# EasyEDA Pro project URADORRY-SUN1.2.eprj, schematic Sub - MAX3421E(1.2)
Create Date: 2024-06-10; Page Name: base; Project Name: URADORRY-SUN; Schematic Name: Sub - MAX3421E(1.2); Update Date: 2024-06-11; Add into BOM: yes; Company: 整数71の情報処理; Convert to PCB: yes; Drawed: 整数71
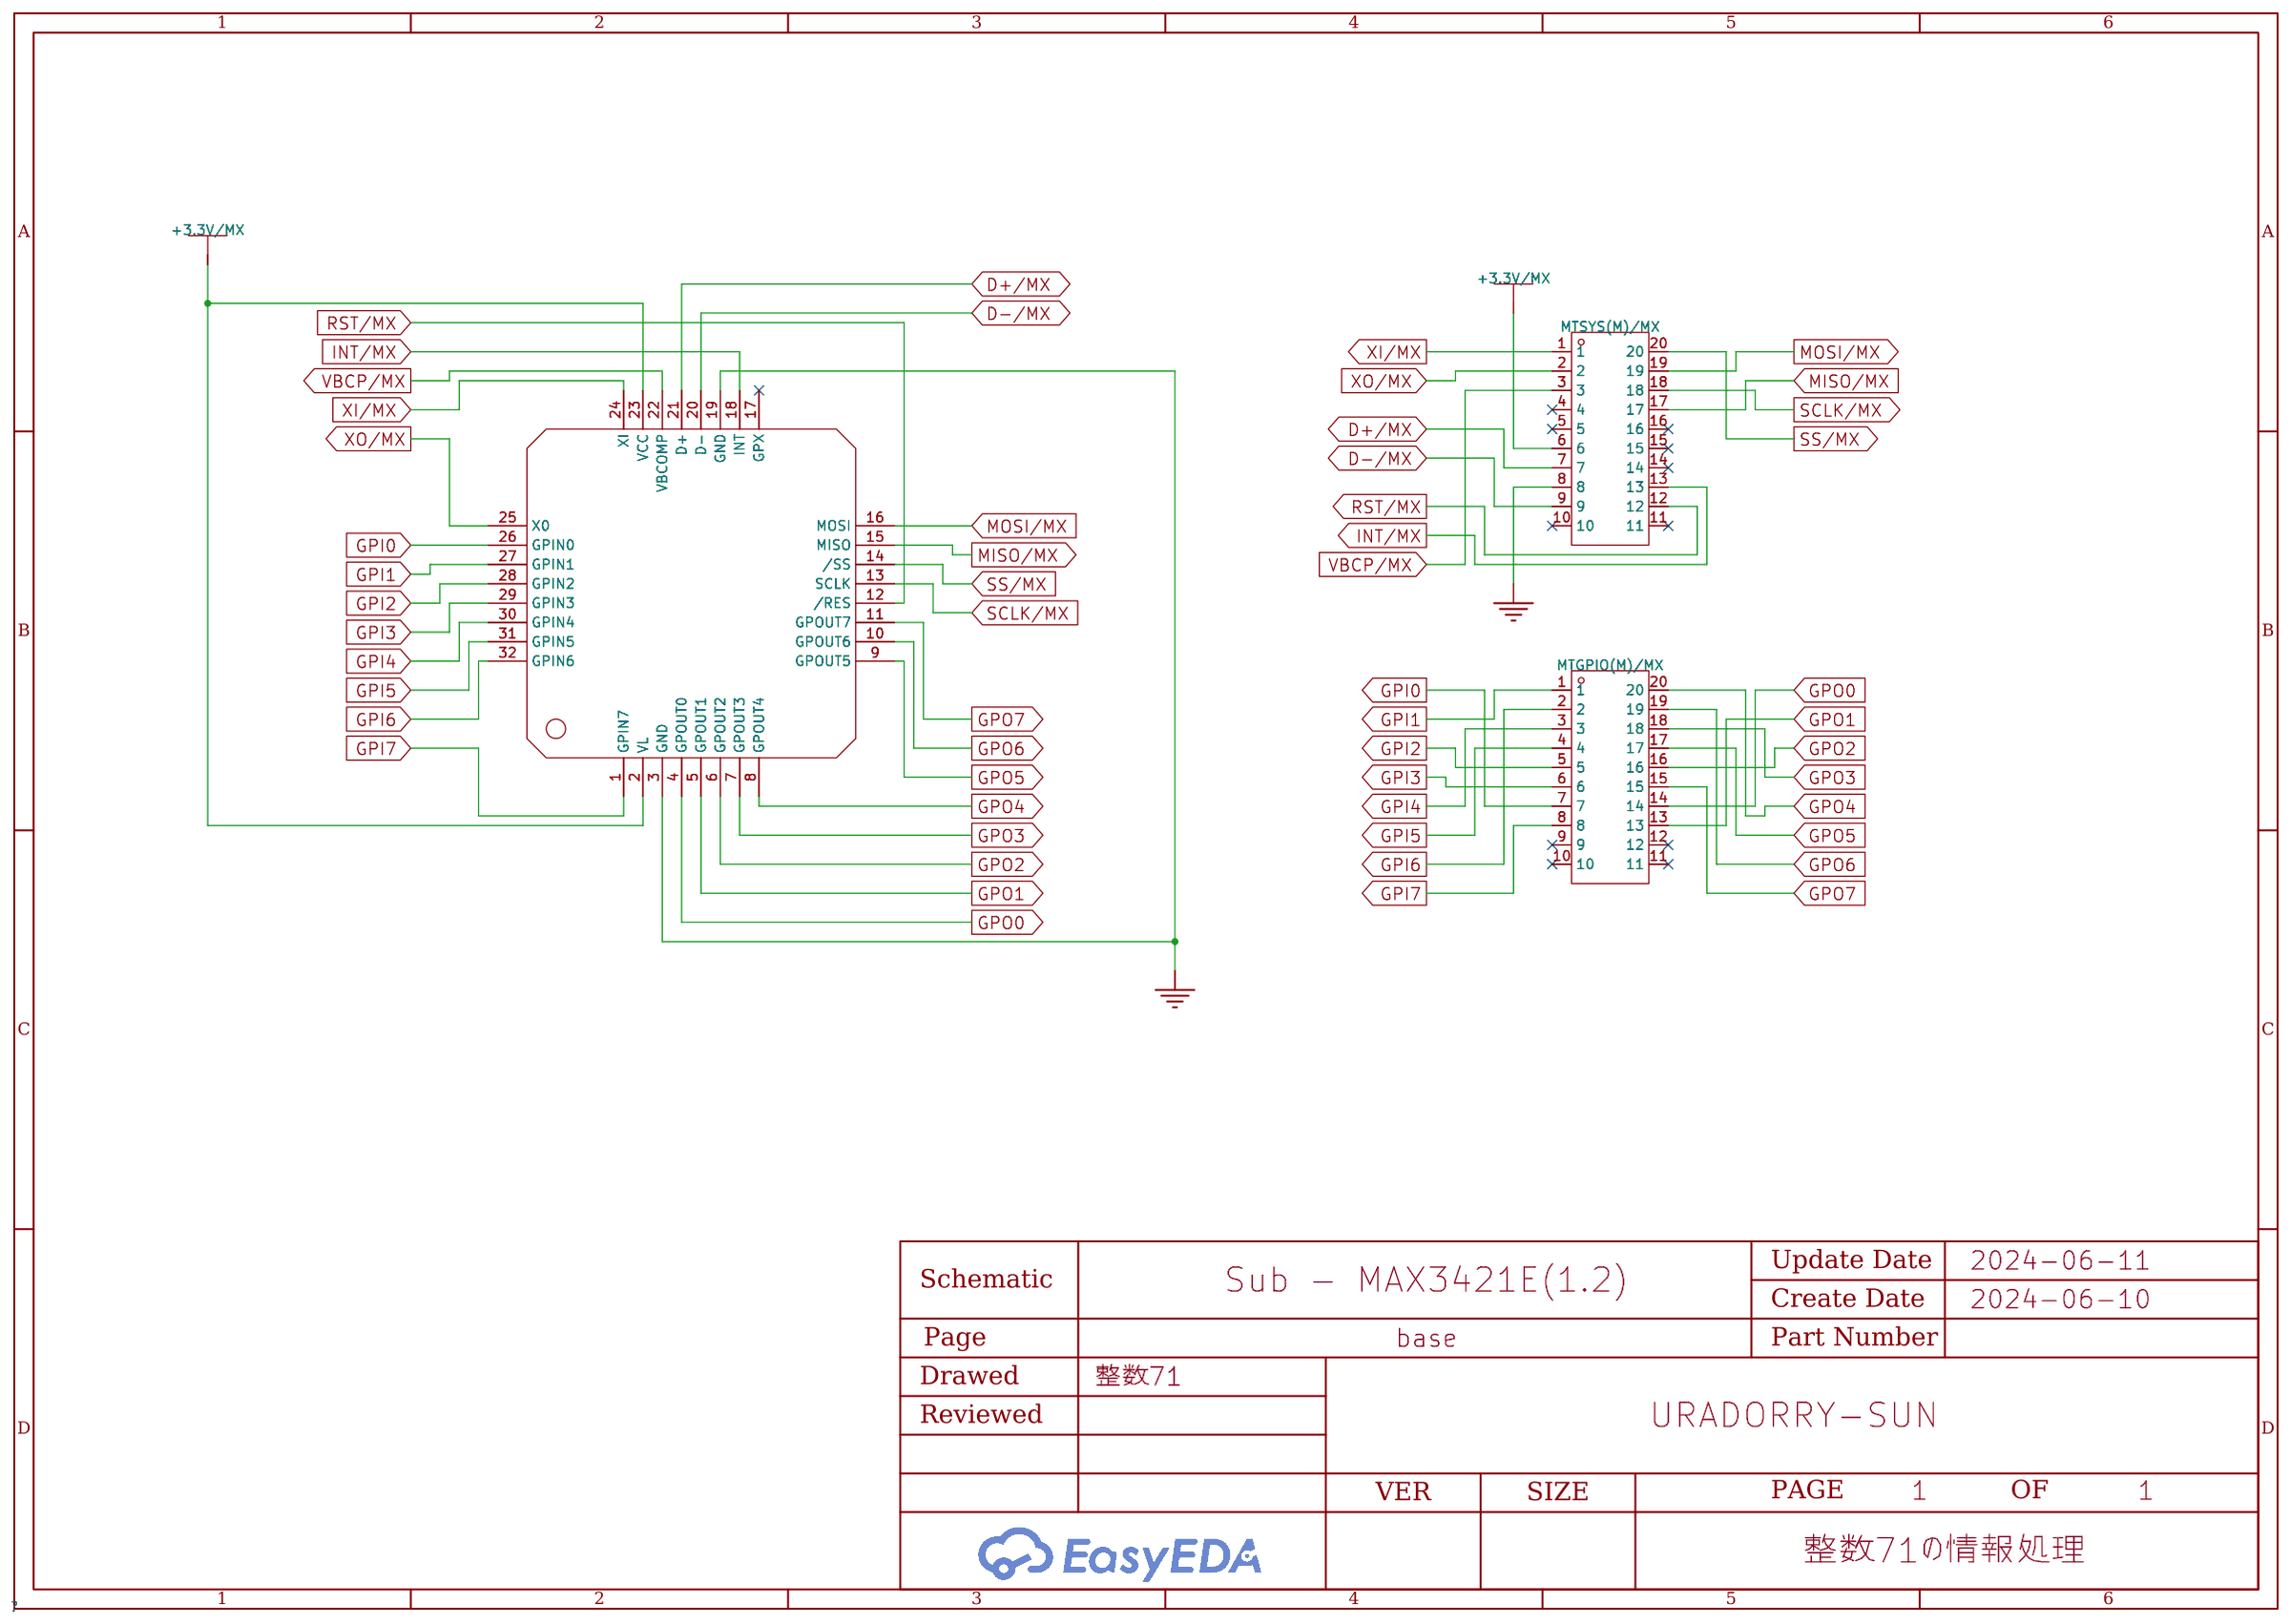
[diagram p0: schematic sheet]

## Parts
MAX3421E  MAX3421EEHJ+T  [TQFP-32_L5.0-W5.0-P0.50-LS7.0-BL]
MTGPIO(M)/MX  AXK6F20547YG  [CONN-SMD_20P-P0.50_C2917022]
MTSYS(M)/MX  AXK6F20547YG  [CONN-SMD_20P-P0.50_C2917022]

## Library data of the parts
MAX3421E = MAX3421EEHJ+T: Applications Function: Protocol:SPI Supply Voltage:3V~3.6V Supply Voltage:3V~3.6V Operating Temperature:-40℃~+85℃ Operating Temperature:-40℃~+85℃; Supplier Part: C2651881; Manufacturer: ADI(亚德诺)/MAXIM(美信); Supplier Footprint: TQFP-32(5x5); JLCPCB Part Class: Extended Part; Datasheet: https://atta.szlcsc.com/upload/public/pdf/source/20210605/F813BE6628303343E236A60FF1C5CBC3.pdf; Supplier: LCSC; Protocol: SPI; Supply Voltage: 3V~3.6V; Operating Temperature: -40℃~+85℃; Check: true
MTGPIO(M)/MX MTSYS(M)/MX = Mezzanine(20M) - SMD0.5mm: Number of Pins:- Pitch:0.5mm Gender:公 Mounting Style:Brick nogging Number of Rows:2 Contact Plating:Gold; LCSC Part Name: 间距:0.5mm 公 立贴; Supplier Part: C2917022; Manufacturer: PANASONIC(松下); Supplier Footprint: SMD,P=0.5mm; JLCPCB Part Class: Extended Part; Datasheet: https://atta.szlcsc.com/upload/public/pdf/source/20220311/6F5DC41F043C9CF6954EB51995931AE2.pdf; Supplier: LCSC; Pitch: 0.5mm; Gender: 公; Mounting Style: Brick nogging; Number of Rows: 2; Contact Plating: Gold

## Nets
GND: MAX3421E.3(GND) MAX3421E.19(GND) MTSYS(M)/MX.8
+3.3V/MX: MAX3421E.2(VL) MAX3421E.23(VCC) MTSYS(M)/MX.6
D+/MX: MAX3421E.21(D+) MTSYS(M)/MX.7
D-/MX: MAX3421E.20(D-) MTSYS(M)/MX.9
GPI0: MAX3421E.26(GPIN0) MTGPIO(M)/MX.7
GPI1: MAX3421E.27(GPIN1) MTGPIO(M)/MX.1
GPI2: MAX3421E.28(GPIN2) MTGPIO(M)/MX.5
GPI3: MAX3421E.29(GPIN3) MTGPIO(M)/MX.6
GPI4: MAX3421E.30(GPIN4) MTGPIO(M)/MX.3
GPI5: MAX3421E.31(GPIN5) MTGPIO(M)/MX.4
GPI6: MAX3421E.32(GPIN6) MTGPIO(M)/MX.2
GPI7: MAX3421E.1(GPIN7) MTGPIO(M)/MX.8
GPO0: MAX3421E.4(GPOUT0) MTGPIO(M)/MX.14
GPO1: MAX3421E.5(GPOUT1) MTGPIO(M)/MX.13
GPO2: MAX3421E.6(GPOUT2) MTGPIO(M)/MX.16
GPO3: MAX3421E.7(GPOUT3) MTGPIO(M)/MX.18
GPO4: MAX3421E.8(GPOUT4) MTGPIO(M)/MX.20
GPO5: MAX3421E.9(GPOUT5) MTGPIO(M)/MX.17
GPO6: MAX3421E.10(GPOUT6) MTGPIO(M)/MX.19
GPO7: MAX3421E.11(GPOUT7) MTGPIO(M)/MX.15
INT/MX: MAX3421E.18(INT) MTSYS(M)/MX.13
MISO/MX: MAX3421E.15(MISO) MTSYS(M)/MX.17
MOSI/MX: MAX3421E.16(MOSI) MTSYS(M)/MX.19
RST/MX: MAX3421E.12(/RES) MTSYS(M)/MX.12
SCLK/MX: MAX3421E.13(SCLK) MTSYS(M)/MX.18
SS/MX: MAX3421E.14(/SS) MTSYS(M)/MX.20
VBCP/MX: MAX3421E.22(VBCOMP) MTSYS(M)/MX.3
XI/MX: MAX3421E.24(XI) MTSYS(M)/MX.1
XO/MX: MAX3421E.25(X0) MTSYS(M)/MX.2

Not connected (* = marked no-connect by the designer): MAX3421E 17(GPX)*; MTGPIO(M)/MX 9* 10* 11* 12*; MTSYS(M)/MX 4* 5* 10* 11* 14* 15* 16*
